# EAGLE schematic yrl040-bugfix1 (EAGLE 9.4.2) (continued)
## Sheet 3 of 4: Arduino (continued)
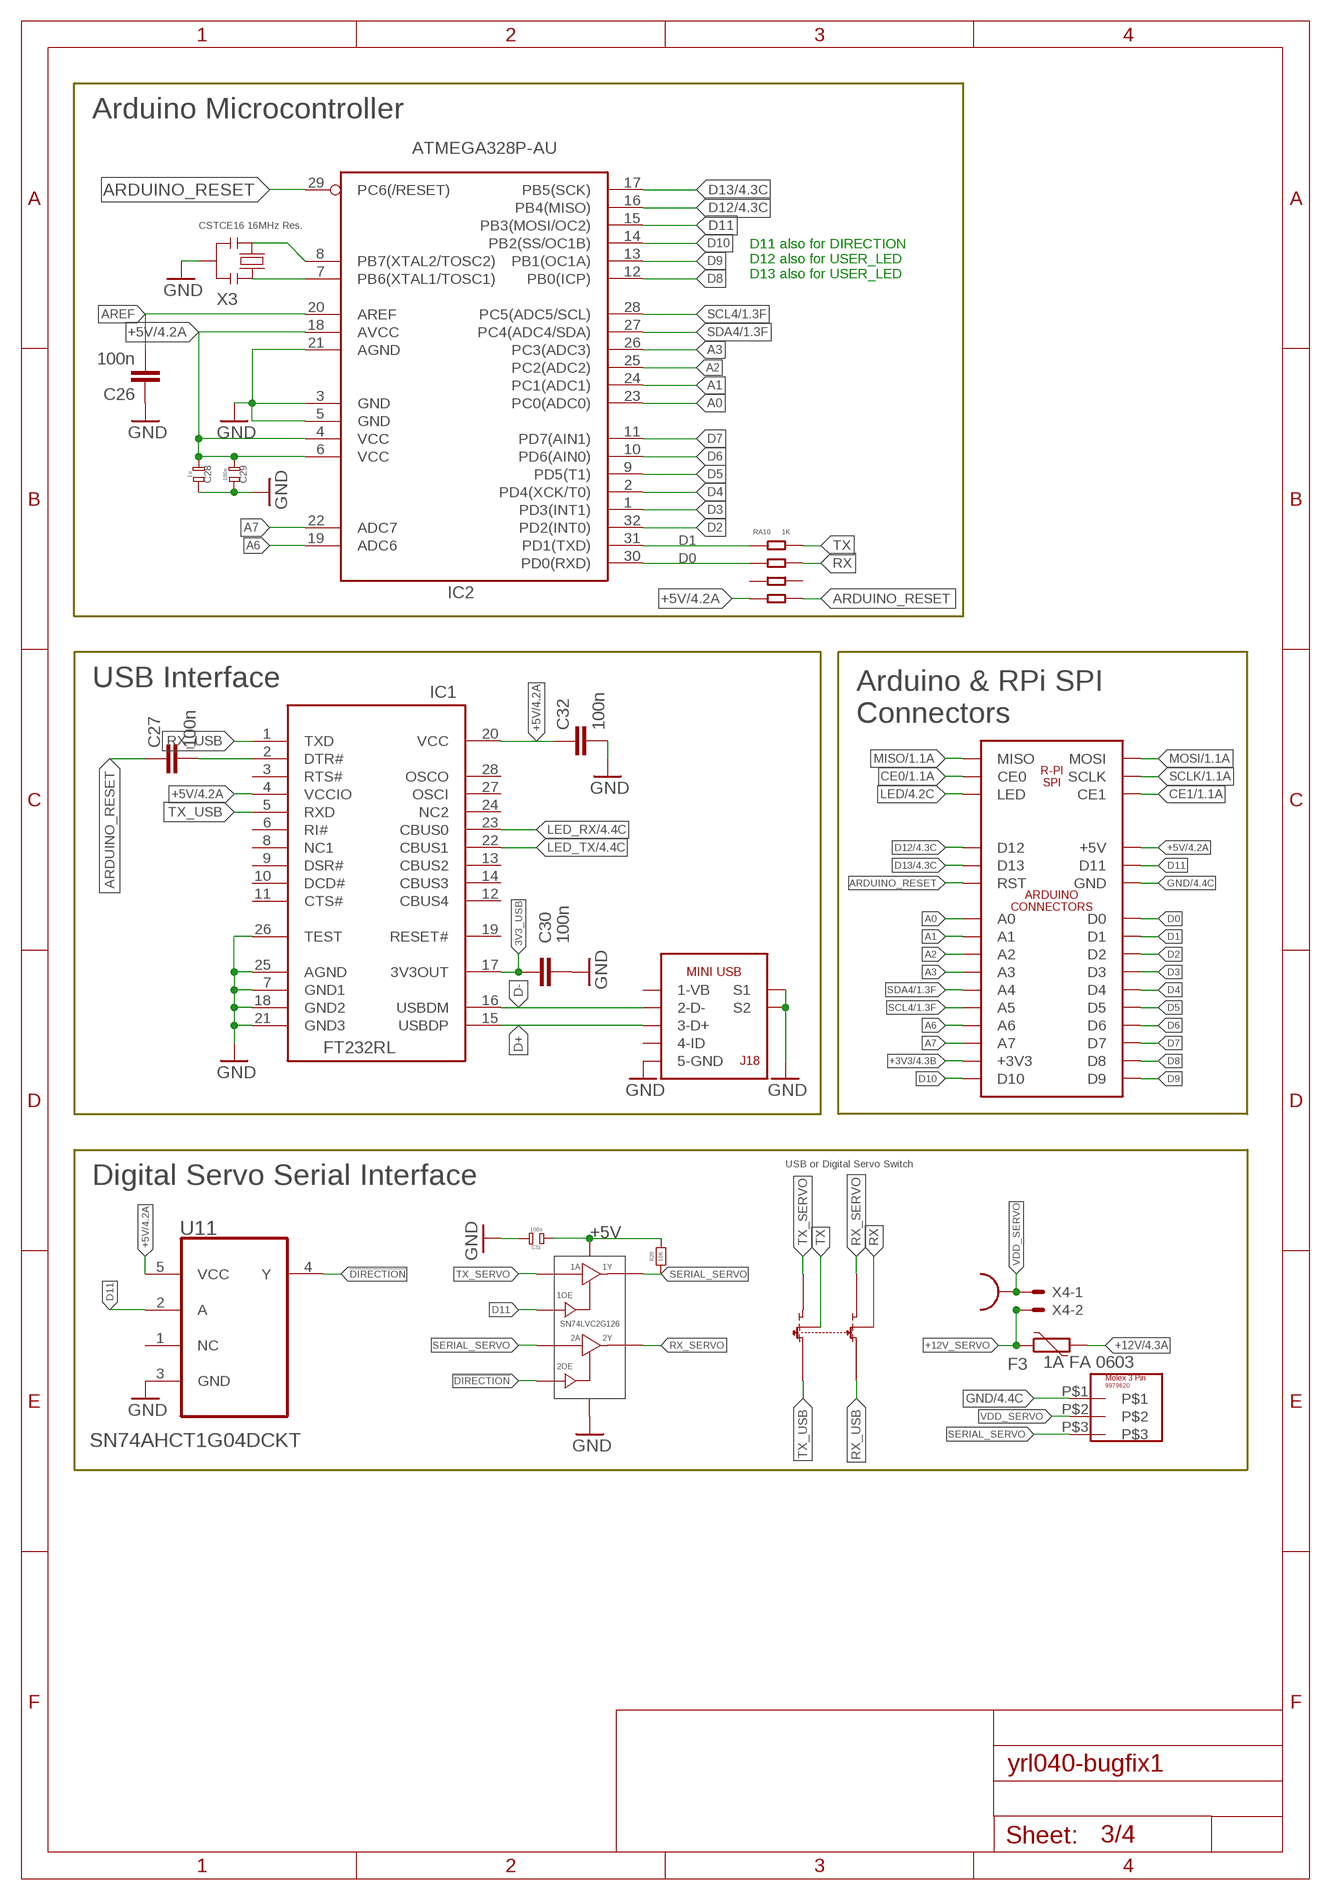
[diagram p2: schematic, sheet 3]

### Parts
C26  100n  C-EUC0603  [C0603]
C27  100n  C-EUC0603  [C0603]
C28  1u  CAPACITOR-0603  [0603-RESISTOR]
C29  100n  CAPACITOR-0603  [0603-RESISTOR]
C30  100n  C-EUC0603  [C0603]
C31  100n  CAPACITOR-0603  [0603-RESISTOR]
C32  100n  C-EUC0603  [C0603]
F3  1A FA 0603  PTC  [0603-1608X90N]
IC1  FT232RL  0226_FT232RL  [SSOP28]
IC2  ATMEGA328P-AU  0265_ATMEGA328P-AU  [TQFP32-08]
J18  MINI-USB  [MINIUSB-VERT-1841175]
J19  ARDUINO-CONNECTORS  [2X10-PIN-ARDUINO]
J20  VIN-POINT  [VIN_PIN]
J21  MOLEX3PIN-9979620  [MOLEX-3PIN-9979620]
R20  10K  RESISTOR-0603  [0603-RESISTOR]
RA10  1K  1206-RES-ARRAY-1770134  [1206-RES-ARRAY]
SW5  DPDT-SWITCH-2320018  [DPDT-SWITCH-2320018]
U11  SN74AHCT1G04DCKT  [SOT65P210X110-5N]
U12  SN74LVC2G126DCUT-1741035  [SN74LVC2G1260DCU]
X3  CSTCE16 16MHz Res.  0011_CSTCE16M0V53-R0  [RESONATOR]
X4  CON-MOLEX_87758-0216  [CON-MOLEX_87758-0216]

### Nets
3V3_USB: C30.1 IC1.17(3V3OUT)
!DIRECTION: U11.4(Y) U12.7(2OE)
+3V3: J19.+3V3 ; also sheet 1,2,4
+5V: C28.1(SD1) C29.1(SD1) C31.1(SD1) C32.1 IC1.4(VCCIO) IC1.20(VCC) IC2.4(VCC) IC2.6(VCC) IC2.18(AVCC) J19.+5V R20.2(SD2) RA10.P$4 U11.5(VCC) U12.8(VCC) ; also sheet 1,2,4
+12V: F3.2 ; also sheet 1,4
+12V_SERVO: F3.1 X4.2
A0: IC2.23(PC0(ADC0)) J19.A0
A1: IC2.24(PC1(ADC1)) J19.A1
A2: IC2.25(PC2(ADC2)) J19.A2
A3: IC2.26(PC3(ADC3)) J19.A3
A6: IC2.19(ADC6) J19.A6
A7: IC2.22(ADC7) J19.A7
ARDUINO_RESET: C27.2 IC2.29(PC6(/RESET)) J19.RST RA10.P$5
AREF: C26.2 IC2.20(AREF)
CE0: J19.CE0 ; also sheet 1
CE1: J19.CE1 ; also sheet 1
D0: IC2.30(PD0(RXD)) J19.D0 RA10.P$2
D1: IC2.31(PD1(TXD)) J19.D1 RA10.P$1
D2: IC2.32(PD2(INT0)) J19.D2
D3: IC2.1(PD3(INT1)) J19.D3
D4: IC2.2(PD4(XCK/T0)) J19.D4
D5: IC2.9(PD5(T1)) J19.D5
D6: IC2.10(PD6(AIN0)) J19.D6
D7: IC2.11(PD7(AIN1)) J19.D7
D8: IC2.12(PB0(ICP)) J19.D8
D9: IC2.13(PB1(OC1A)) J19.D9
D10: IC2.14(PB2(SS/OC1B)) J19.D10
D11: IC2.15(PB3(MOSI/OC2)) J19.D11 U11.2(A) U12.1(1OE)
D12: IC2.16(PB4(MISO)) J19.D12 ; also sheet 4
D13: IC2.17(PB5(SCK)) J19.D13 ; also sheet 4
D+: IC1.15(USBDP) J18.3(3-D+)
D-: IC1.16(USBDM) J18.2(2-D-)
GND: C26.1 C28.2(SD2) C29.2(SD2) C30.2 C31.2(SD2) C32.2 IC1.7(GND1) IC1.18(GND2) IC1.21(GND3) IC1.25(AGND) IC1.26(TEST) IC2.3(GND) IC2.5(GND) IC2.21(AGND) J18.5(5-GND) J18.6(S1) J18.7(S2) J19.GND J21.P$1 U11.3(GND) U12.4(GND) X3.2 ; also sheet 1,2,4
LED: J19.LED ; also sheet 4
LED_RX: IC1.23(CBUS0) ; also sheet 4
LED_TX: IC1.22(CBUS1) ; also sheet 4
MISO: J19.MISO ; also sheet 1
MOSI: J19.MOSI ; also sheet 1
N$88: IC2.7(PB6(XTAL1/TOSC1)) X3.1
N$89: IC2.8(PB7(XTAL2/TOSC2)) X3.3
N$90: C27.1 IC1.2(DTR#)
RX: RA10.P$7 SW5.B_COM
RX_SERVO: SW5.B_2 U12.3(2Y)
RX_USB: IC1.1(TXD) SW5.B_1
SCL4: IC2.28(PC5(ADC5/SCL)) J19.A5 ; also sheet 1,2
SCLK: J19.SCLK ; also sheet 1
SDA4: IC2.27(PC4(ADC4/SDA)) J19.A4 ; also sheet 1,2
SERIAL_SERVO: J21.P$3 R20.1(SD1) U12.5(2A) U12.6(1Y)
TX: RA10.P$8 SW5.A_COM
TX_SERVO: SW5.A_2 U12.2(1A)
TX_USB: IC1.5(RXD) SW5.A_1
VDD_SERVO: J20.P$1 J21.P$2 X4.1
Unconnected: IC1.3(RTS#) IC1.6(RI#) IC1.8(NC1) IC1.9(DSR#) IC1.10(DCD#) IC1.11(CTS#) IC1.12(CBUS4) IC1.13(CBUS2) IC1.14(CBUS3) IC1.19(RESET#) IC1.24(NC2) IC1.27(OSCI) IC1.28(OSCO) J18.1(1-VB) J18.4(4-ID) RA10.P$3 RA10.P$6 U11.1(NC)

### Notes on the sheet
- Arduino Microcontroller
- D11 also for DIRECTION
  D12 also for USER_LED
  D13 also for USER_LED
- USB Interface
- Arduino & RPi SPI
  Connectors
- USB or Digital Servo Switch
- Digital Servo Serial Interface

## Sheet 4 of 4: LED, Compass
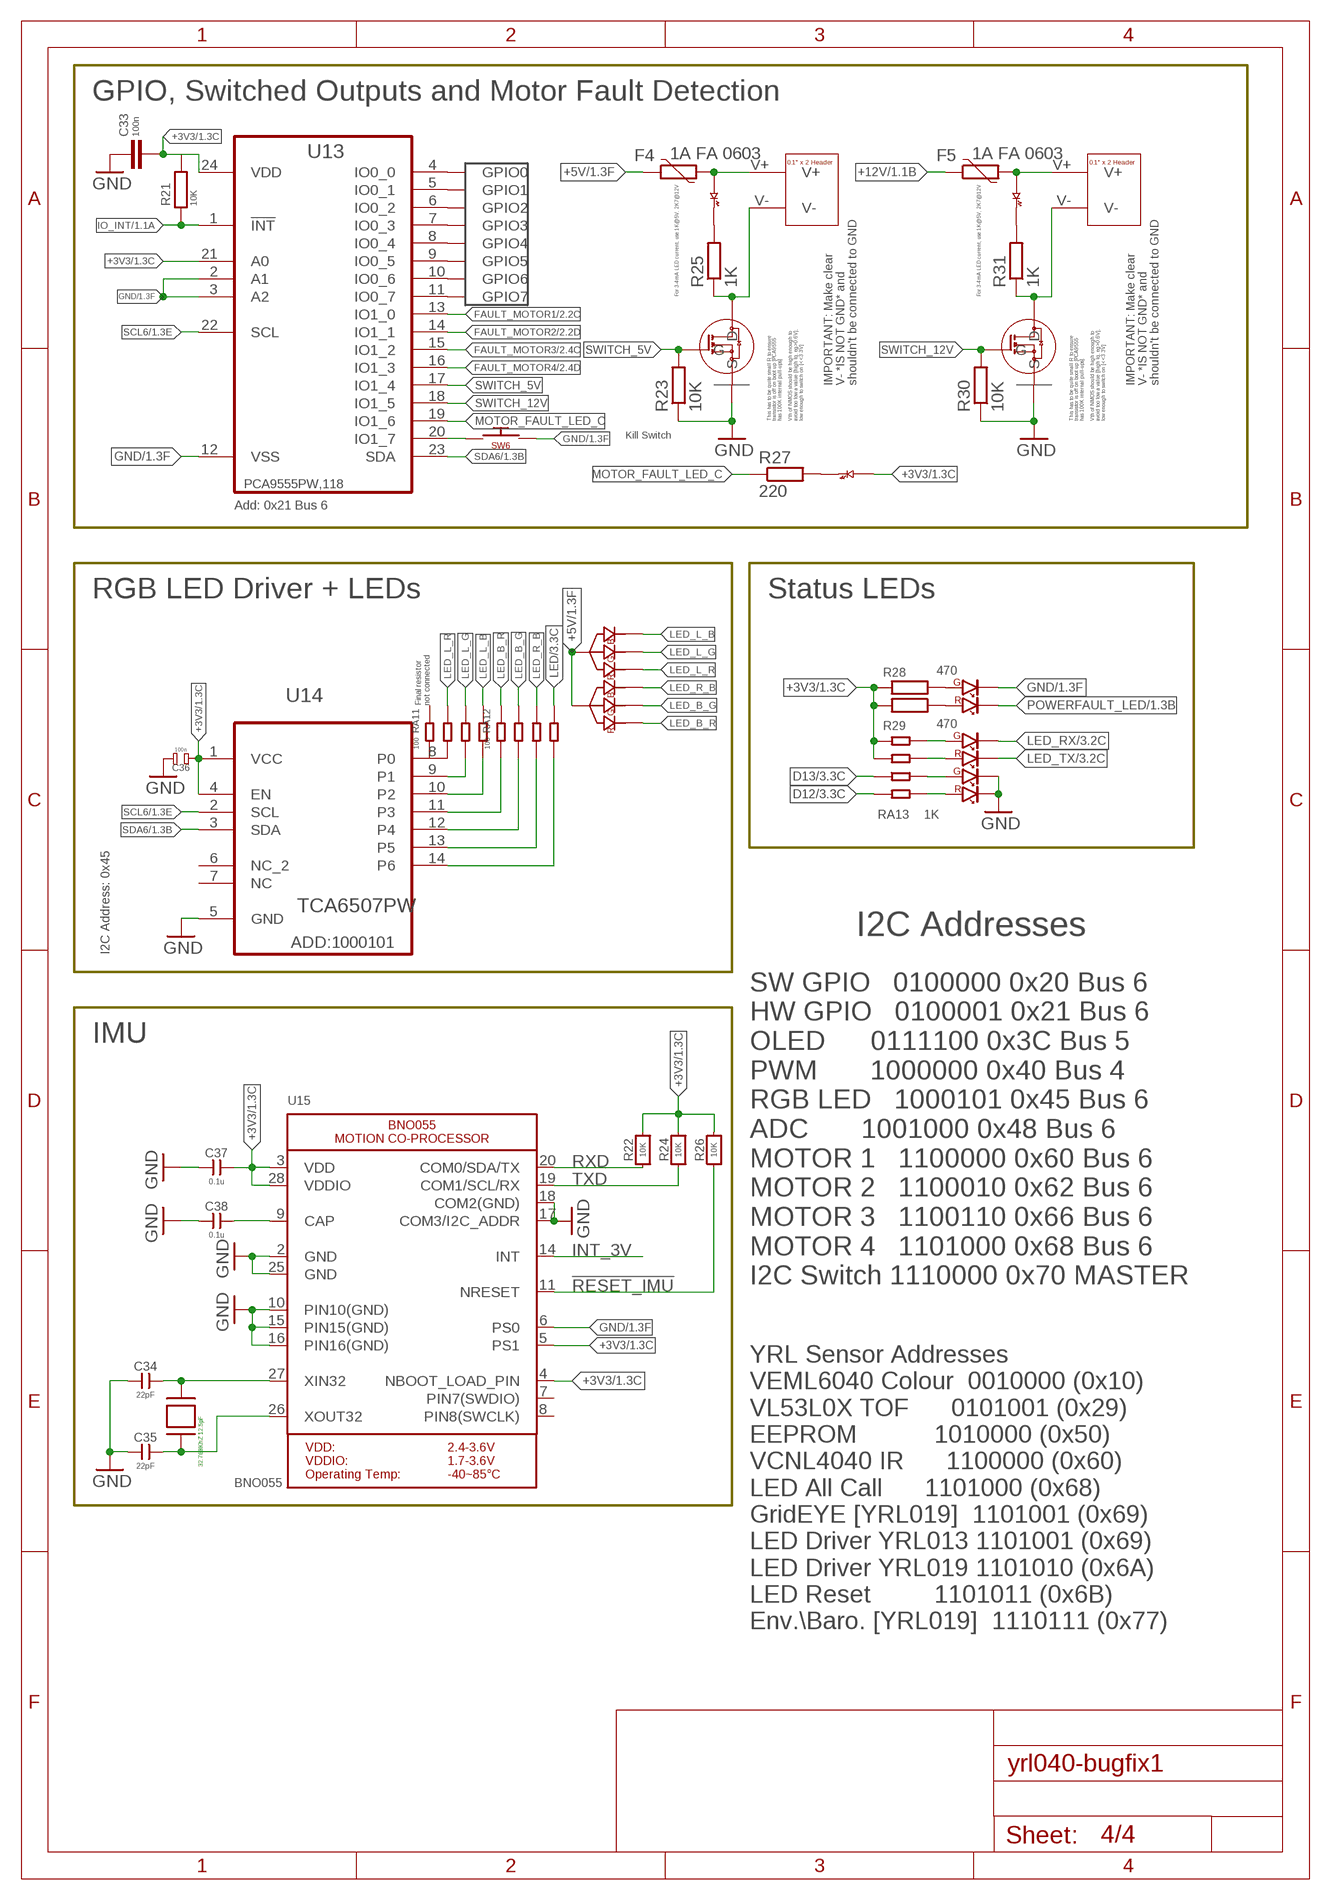
[diagram p3: schematic, sheet 4]

### Parts
C33  100n  C-EUC0603  [C0603]
C34  22pF  CAPACITOR-0603  [0603]
C35  22pF  CAPACITOR-0603  [0603]
C36  100n  CAPACITOR-0603  [0603-RESISTOR]
C37  0.1u  CAPACITOR-0603  [0603]
C38  0.1u  CAPACITOR-0603  [0603]
F4  1A FA 0603  PTC  [0603-1608X90N]
F5  1A FA 0603  PTC  [0603-1608X90N]
J22  GPIO-8PIN  [4X2X0.1"-GPIO]
J23  SPO-2-PIN-HEADER  [2-PIN-SPO]
J24  SPO-2-PIN-HEADER  [2-PIN-SPO]
LED5  2481105-RGB-LED  [2401105-RGB-LED]
LED6  2481105-RGB-LED  [2401105-RGB-LED]
LED7  KPTL-SERIES-REVERSE-MOUNT-LED  [KPTL-SERIES-REVERSE-SMD-LED]
LED8  KPTL-SERIES-REVERSE-MOUNT-LED  [KPTL-SERIES-REVERSE-SMD-LED]
LED9  DUAL-COLOUR-REVERSE-MOUNT-LED  [SML-825X-SERIES]
LED10  DUAL-COLOUR-REVERSE-MOUNT-LED  [SML-825X-SERIES]
LED11  DUAL-COLOUR-REVERSE-MOUNT-LED  [SML-825X-SERIES]
LED12  KPTL-SERIES-REVERSE-MOUNT-LED  [KPTL-SERIES-REVERSE-SMD-LED]
Q1  BSR802N-MOSFET-2443469  [BSR802N-NMOS]
Q2  BSR802N-MOSFET-2443469  [BSR802N-NMOS]
R21  10K  R-EU_R0603  [R0603]
R22  10K  RESISTOR-0603  [0603]
R23  10K  R-EU_R0603  [R0603]
R24  10K  RESISTOR-0603  [0603]
R25  1K  R-EU_R0603  [R0603]
R26  10K  RESISTOR-0603  [0603]
R27  220  R-EU_R0603  [R0603]
R28  470  R-EU_R0603  [R0603]
R29  470  R-EU_R0603  [R0603]
R30  10K  R-EU_R0603  [R0603]
R31  1K  R-EU_R0603  [R0603]
RA11  100  1206-RES-ARRAY-1770134  [1206-RES-ARRAY]
RA12  100  1206-RES-ARRAY-1770134  [1206-RES-ARRAY]
RA13  1K  1206-RES-ARRAY-1770134  [1206-RES-ARRAY]
SW6  SWITCH-9471898  [6X3.5-SWITCH]
U13  PCA9555PW,118  [SOP65P640X110-24N]
U14  TCA6507PW  [SOP65P640X120-14N]
U15  BNO055  MICROBUILDER_BNO055  [MICROBUILDER_BNO055]
X5  CRYSTAL-2X1.2  [CRYSTAL-2X1.2]

### Nets
!RESET_IMU: R26.P$1 U15.11(NRESET) ; also sheet 1
+3V3: C33.2 C36.1(SD1) C37.P$2 LED8.ANODE R21.2 R22.P$2 R24.P$2 R26.P$2 R28.2 R29.2 RA13.P$1 RA13.P$2 U13.21(A0) U13.24(VDD) U14.1(VCC) U14.4(EN) U15.3(VDD) U15.4(NBOOT_LOAD_PIN) U15.5(PS1) U15.28(VDDIO) ; also sheet 1,2,3
+5V: F4.1 LED5.1(ANODE) LED6.1(ANODE) ; also sheet 1,2,3
+12V: F5.1 ; also sheet 1,3
D12: RA13.P$4 ; also sheet 3
D13: RA13.P$3 ; also sheet 3
FAULT_MOTOR1: U13.13(IO1_0) ; also sheet 2
FAULT_MOTOR2: U13.14(IO1_1) ; also sheet 2
FAULT_MOTOR3: U13.15(IO1_2) ; also sheet 2
FAULT_MOTOR4: U13.16(IO1_3) ; also sheet 2
GND: C33.1 C34.P$1 C35.P$1 C36.2(SD2) C37.P$1 C38.P$1 LED9.4-GREEN-CATHODE LED11.2_RED-CATHODE(2-RED-CATHODE) LED11.4-GREEN-CATHODE Q1.2-S(S) Q2.2-S(S) R23.1 R30.1 SW6.2(SD2) U13.2(A1) U13.3(A2) U13.12(VSS) U14.5(GND) U15.2(GND) U15.6(PS0) U15.10(PIN10(GND)) U15.15(PIN15(GND)) U15.16(PIN16(GND)) U15.17(COM3/I2C_ADDR) U15.18(COM2(GND)) U15.25(GND) ; also sheet 1,2,3
INT_3V: U15.14(INT)
IO_INT: R21.1 U13.1(!INT) ; also sheet 1
LED: RA12.P$4 ; also sheet 3
LED_B_G: LED6.3(K_GREEN) RA12.P$2
LED_B_R: LED6.4(K_RED) RA12.P$1
LED_L_B: LED5.2(K_BLUE) RA11.P$4
LED_L_G: LED5.3(K_GREEN) RA11.P$3
LED_L_R: LED5.4(K_RED) RA11.P$2
LED_R_B: LED6.2(K_BLUE) RA12.P$3
LED_RX: LED10.4-GREEN-CATHODE ; also sheet 3
LED_TX: LED10.2_RED-CATHODE(2-RED-CATHODE) ; also sheet 3
MOTOR_FAULT_LED_C: R27.1 U13.19(IO1_6)
N$61: J22.GPIO0 U13.4(IO0_0)
N$62: J22.GPIO1 U13.5(IO0_1)
N$63: J22.GPIO2 U13.6(IO0_2)
N$64: J22.GPIO3 U13.7(IO0_3)
N$65: J22.GPIO4 U13.8(IO0_4)
N$66: J22.GPIO5 U13.9(IO0_5)
N$67: J22.GPIO6 U13.10(IO0_6)
N$68: J22.GPIO7 U13.11(IO0_7)
N$71: LED8.CATHODE R27.2
N$72: LED7.CATHODE R25.2
N$73: J23.V- Q1.3-D(D) R25.1
N$74: F4.2 J23.V+ LED7.ANODE
N$75: LED12.CATHODE R31.2
N$76: J24.V- Q2.3-D(D) R31.1
N$77: F5.2 J24.V+ LED12.ANODE
N$78: RA11.P$6 U14.9(P1)
N$79: RA11.P$5 U14.10(P2)
N$80: RA12.P$8 U14.11(P3)
N$81: RA12.P$7 U14.12(P4)
N$82: RA12.P$6 U14.13(P5)
N$83: RA12.P$5 U14.14(P6)
N$84: RA11.P$7 U14.8(P0)
N$85: C34.P$2 U15.27(XIN32) X5.P$1
N$86: C35.P$2 U15.26(XOUT32) X5.P$2
N$87: C38.P$2 U15.9(CAP)
N$92: LED10.1-RED_ANODE(1-RED-ANODE) RA13.P$7
N$93: LED10.3-GREEN-ANODE RA13.P$8
N$94: LED11.3-GREEN-ANODE RA13.P$6
N$95: LED11.1-RED_ANODE(1-RED-ANODE) RA13.P$5
N$96: LED9.3-GREEN-ANODE R28.1
N$97: LED9.1-RED_ANODE(1-RED-ANODE) R29.1
POWERFAULT_LED: LED9.2_RED-CATHODE(2-RED-CATHODE) ; also sheet 1
RESET: SW6.1(SD1) U13.20(IO1_7)
RXD: R22.P$1 U15.20(COM0/SDA/TX) ; also sheet 1
SCL6: U13.22(SCL) U14.2(SCL) ; also sheet 1,2
SDA6: U13.23(SDA) U14.3(SDA) ; also sheet 1,2
SWITCH_5V: Q1.1-G(G) R23.2 U13.17(IO1_4)
SWITCH_12V: Q2.1-G(G) R30.2 U13.18(IO1_5)
TXD: R24.P$1 U15.19(COM1/SCL/RX) ; also sheet 1
Unconnected: RA11.P$1 RA11.P$8 U14.6(NC_2) U14.7(NC) U15.7(PIN7(SWDIO)) U15.8(PIN8(SWCLK))

### Notes on the sheet
- GPIO, Switched Outputs and Motor Fault Detection
- For 3-4mA LED current, use 1K@5V, 2K7@12V | For 3-4mA LED current, use 1K@5V, 2K7@12V
- IMPORTANT: Make clear
  V- *IS NOT GND* and
  shouldn't be connected to GND
- IMPORTANT: Make clear
  V- *IS NOT GND* and
  shouldn't be connected to GND
- This has to be quite small R to ensure
  transistor is off on boot up [PCA9555
  has 100K internal pull-ups].
  
  Vth of NMOS should be high enough to
  avoid too low a value [high Iq, eg>0.6V],
  low enough to switch on [<<3.3V]
- This has to be quite small R to ensure
  transistor is off on boot up [PCA9555
  has 100K internal pull-ups].
  
  Vth of NMOS should be high enough to
  avoid too low a value [high Iq, eg>0.6V],
  low enough to switch on [<<3.3V]
- Kill Switch
- Add: 0x21 Bus 6
- RGB LED Driver + LEDs | Status LEDs
- Final resistor 
  not connected
- ADD:1000101 | I2C Addresses
- I2C Address: 0x45
- SW GPIO   0100000 0x20 Bus 6
  HW GPIO   0100001 0x21 Bus 6
  OLED      0111100 0x3C Bus 5
  PWM       1000000 0x40 Bus 4
  RGB LED   1000101 0x45 Bus 6
  ADC       1001000 0x48 Bus 6
  MOTOR 1   1100000 0x60 Bus 6
  MOTOR 2   1100010 0x62 Bus 6
  MOTOR 3   1100110 0x66 Bus 6
  MOTOR 4   1101000 0x68 Bus 6
  I2C Switch 1110000 0x70 MASTER
- IMU
- YRL Sensor Addresses
  VEML6040 Colour  0010000 (0x10)
  VL53L0X TOF      0101001 (0x29)
  EEPROM           1010000 (0x50)
  VCNL4040 IR      1100000 (0x60)
  LED All Call      1101000 (0x68)
  GridEYE [YRL019]  1101001 (0x69)
  LED Driver YRL013 1101001 (0x69)
  LED Driver YRL019 1101010 (0x6A)
  LED Reset         1101011 (0x6B)
  Env.\Baro. [YRL019]  1110111 (0x77)
- 32.768KhZ 12.5pF

## Library data of the parts
C1 = resistor:C-EU: CAPACITOR, European symbol
C2 C4 C5 C7 C13-C19 C22 C23 C28 C29 C31 C36 = idea:CAPACITOR-0603
C3 C6 C8 = YRL-Passives:CAPACITOR-0805
C9-C12 C20 C21 C24 C25 C33 = rcl:C-EU: CAPACITOR, European symbol; SPICEPREFIX: C
C26 C27 C30 C32 = rcl:C-EU: CAPACITOR, European symbol
C34 C35 C37 C38 = YRL-Passives:CAPACITOR-0603
F1-F5 = Arduino-rcl:PTC: SMD PTC; DATASHEET: http://www.bourns.com/docs/Product-Datasheets/mffsmf.pdf; DISTRIBUTOR-LINK: http://www.digikey.com/product-detail/en/bourns-inc/MF-FSMF050X-2/MF-FSMF050X-2CT-ND/2039389; DISTRIBUTOR-PN: MF-FSMF050X-2CT-ND; MANUFACTURER: Bourns Inc; MANUFACTURER-PN: MF-FSMF050X-2; VALUE: MFFSMF050
IC1 = IntegratedCircuits:0226_FT232RL: USB to serial UART interface -FT232RL; CASE: SSOP28; MONTHLY_USAGE: _____; PART_NUMBER: FT232RL; PRICE: _____; SUPPLIER: _____; TYPE: Circuito_Integrato
IC2 = IntegratedCircuits:0265_ATMEGA328P-AU: 8-bit Microcontroller with 32KBytes In-System Programmable Flash ATMEGA328P-AU; CASE: TQFP32_7x7; MONTHLY_USAGE: _____; PART_NUMBER: ATMEGA328P-AU; PRICE: _____; SUPPLIER: _____; TYPE: Circuito_Integrato
J1 = yrl012-exported:CONNECTOR-PAIRS
J2-J5 = YRL040:I2C-BLOCK-2
J6 = YRL028-002:YRL012-EXPORTED_ADA-128X32-DISPLAY
J7 = yrl040-library:SERVO_CONNECTION_BLOCK
J8 J9 J16 J17 = yrl040-library:WAGO-233-502-TERMINAL
J10-J15 = yrl012-exported:SHARP-SENSOR
J18 = yrl025-andgate:MINI-USB
J19 = yrl040-library:ARDUINO-CONNECTORS
J20 = yrl040-library:VIN-POINT
J21 = mbed_library:MOLEX3PIN-9979620
J22 = yrl040-library:GPIO-8PIN
J23 J24 = yrl040-library:SPO-2-PIN-HEADER
LED1-LED4 LED7 LED8 LED12 = yrl040-library:KPTL-SERIES-REVERSE-MOUNT-LED
LED5 LED6 = yrl012-exported:2481105-RGB-LED
LED9-LED11 = yrl040-library:DUAL-COLOUR-REVERSE-MOUNT-LED: ROHM SML-822X SML-825X SERIES, 2908899
LOGO1 = yrl028-library:YRL-2019-LOGO
MIC1 = yrl040-26:MICROBUILDER_MIC_I2S
Q1 Q2 = yrl039-library:BSR802N-MOSFET-2443469
R1 R2 R4-R6 R8-R10 R20 = idea:RESISTOR-0603
R3 R7 R21 = resistor:R-EU_: RESISTOR, European symbol
R11-R18 = rcl:R-EU_: RESISTOR, European symbol
R19 = yrl040-library:R-EU_: RESISTOR, European symbol
R22 R24 R26 = YRL-Passives:RESISTOR-0603
R23 R25 R27-R31 = rcl:R-EU_: RESISTOR, European symbol; SPICEPREFIX: R
RA1-RA9 RA11-RA13 = yrl012-exported:1206-RES-ARRAY-1770134
RA10 = yrl012-exported2:1206-RES-ARRAY-1770134
SCREEN1 = yrl040-library:YRK-SCREEN-2
SW1 = yrl040-26:PSISWARM15LIBRARYPSI-SWARM-1-5_01-ROBOT_4-WAY-DIP-1524007-MCEMR-04-T
SW2 SW3 = JAH-PiPuck:PUSH-SWITCH-EVPAS-SERIES
SW4 = yrl040-26:PSISWARM15LIBRARYPSI-SWARM-1-5_01-ROBOT_5-WAY-SWITCH
SW5 = yrl025-andgate:DPDT-SWITCH-2320018
SW6 = epuck-zero-lib:SWITCH-9471898
U1 = yrl012-exported2:MCP1824T-3302E/OT: 300 mA, Low Voltage, Low Quiescent Current LDO Regulator; MPN: MCP1824T-3302E/OT; OC_FARNELL: 1578387; OC_NEWARK: 40M0704; PACKAGE: SOT23-5; SUPPLIER: Microchip
U2 = PCA9548APWR:PCA9548APWR: 8-CHANNEL I2C SWITCH WITH RESET; DESCRIPTION: 8-Channel I2C Switch With Reset 24-TSSOP -40 to 85; DIGI-KEY_PART_NUMBER: 296-21775-1-ND; DIGI-KEY_PURCHASE_URL: https://www.digikey.co.uk/product-detail/en/texas-instruments/PCA9548APWR/296-21775-1-ND/1629174?utm_source=snapeda&utm_medium=aggregator&utm_campaign=symbol; MF: Texas Instruments; MP: PCA9548APWR; PACKAGE: TSSOP-24 Texas Instruments
U3 = idea:TPA2005D1DGN: 1.4-W MONO FILTER-FREE CLASS-D AUDIO POWER AMPLIFIER; MPN: TPA2005D1DGN; OC_FARNELL: 2075395; OC_NEWARK: 82T3159; PACKAGE: MSOP-8; SUPPLIER: Texas Instruments
U4 U13 = yrl012-exported:PCA9555PW,118: IC, I/O EXPANDER, 16BIT, 24TSSOP; MPN: PCA9555PW,118; OC_FARNELL: 2101299; OC_NEWARK: 70R6680; PACKAGE: 24TSSOP; SUPPLIER: NXP
U5 = yrl040-library:PCA9685PW: 16-channel, 12-bit PWM Fm+ I2C-bus LED controller; MPN: PCA9685PW; OC_FARNELL: 1854074; OC_NEWARK: 19T6398; PACKAGE: TSSOP-28; SUPPLIER: NXP
U6 = prar_library:ADS7830IPWTG4: 8-Bit, 8-Channel Sampling ANALOG-TO-DIGITAL CONVERTER with I2C Interface; MPN: ADS7830IPWTG4; OC_FARNELL: 1180129; OC_NEWARK: 25M7543; PACKAGE: TSSOP-16; SUPPLIER: Texas Instruments
U7-U10 = new-modular-robot-library:DRV8830DGQR: LOW-VOLTAGE MOTOR DRIVER WITH SERIAL INTERFACE; MPN: DRV8830DGQR; OC_FARNELL: 1863106; OC_NEWARK: 58T1482; PACKAGE: MSOP-10; SUPPLIER: TEXAS INSTRUMENTS
U11 = idea:SN74AHCT1G04DCKT: SINGLE INVERTER GATE,SC70-5; MPN: SN74AHCT1G04DCKT; OC_FARNELL: 1902169; OC_NEWARK: 55T3904; PACKAGE: SC70-5; SUPPLIER: TEXAS INSTRUMENTS
U12 = idea:SN74LVC2G126DCUT-1741035
U14 = new-modular-robot-library:TCA6507PW: LOW-VOLTAGE 7-BIT I2C AND SMBus LED DRIVER WITH INTENSITY CONTROL AND SHUTDOWN; MPN: TCA6507PW; OC_FARNELL: 1647813; OC_NEWARK: 54M7301; PACKAGE: TSSOP-14; SUPPLIER: Texas Instruments
U15 = yrl040-26:MICROBUILDER_BNO055: BNO055 - Motion Co-Processor
VR1 = yrl040-library:3386F-TRIMPOT-9354581
X1 X2 X4 = yrl012-exported:CON-MOLEX_87758-0216: 2 Pin - 2mm Dual Row Single Wafer, Vertical T/H HDR Source: http://www.molex.com/pdm_docs/sd/877580616_sd.pdf; MPN: 87758-0216; OC_FARNELL: unknown; OC_NEWARK: 94M1513
X3 = YRL028-007:0011_CSTCE16M0V53-R0: 16Mhz - SMD; MONTHLY_USAGE: _____; PART_NUMBER: CSTCE16M0V53-R0; PRICE: _____; SUPPLIER: _____; TYPE: Cristalli; VALUE: CSTCE16M0V53-R0
X5 = yrl040-library:CRYSTAL-2X1.2